# EasyEDA Pro project 15F1D_EDA.eprj

# Schematic 15F_SCH

## Sheets
1 MOT: Create Date: 2024-05-13; Page Name: MOT; Project Name: 15F1D_EDA; Schematic Name: 15F_SCH; Update Date: 2024-05-15
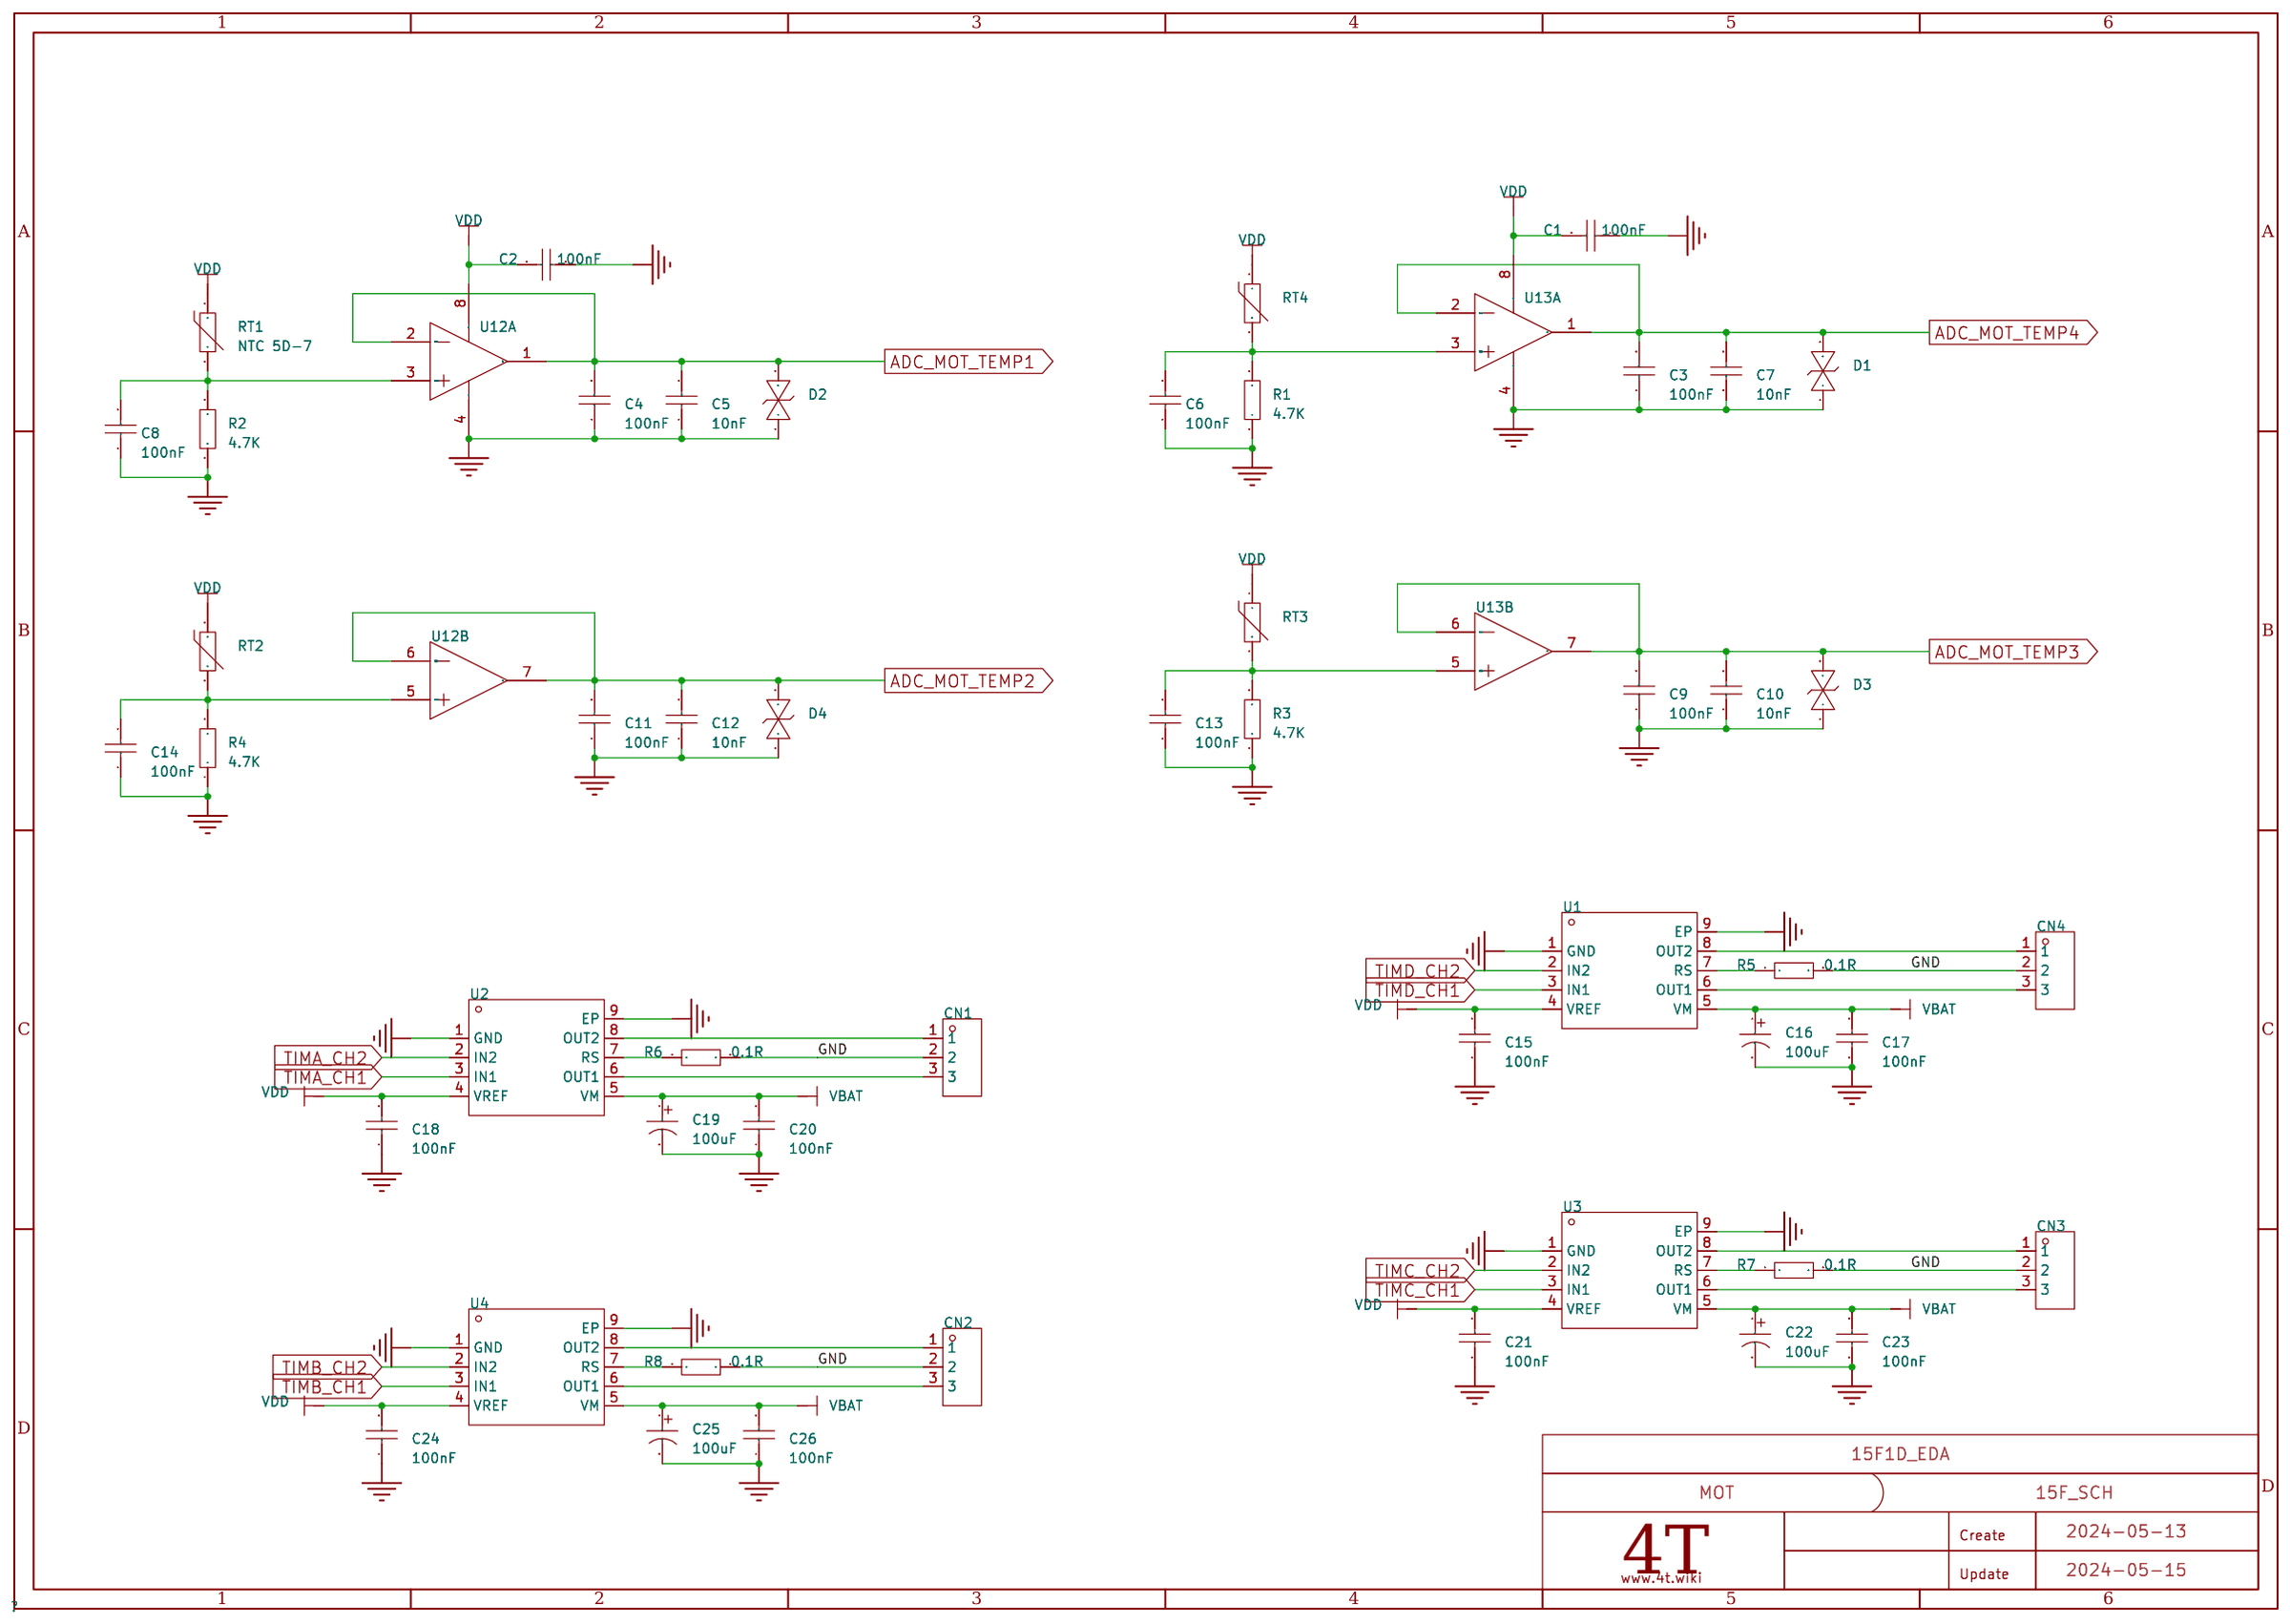
[diagram p0: MOT]
2 COM: Page Name: COM; Update Date: 2024-05-16
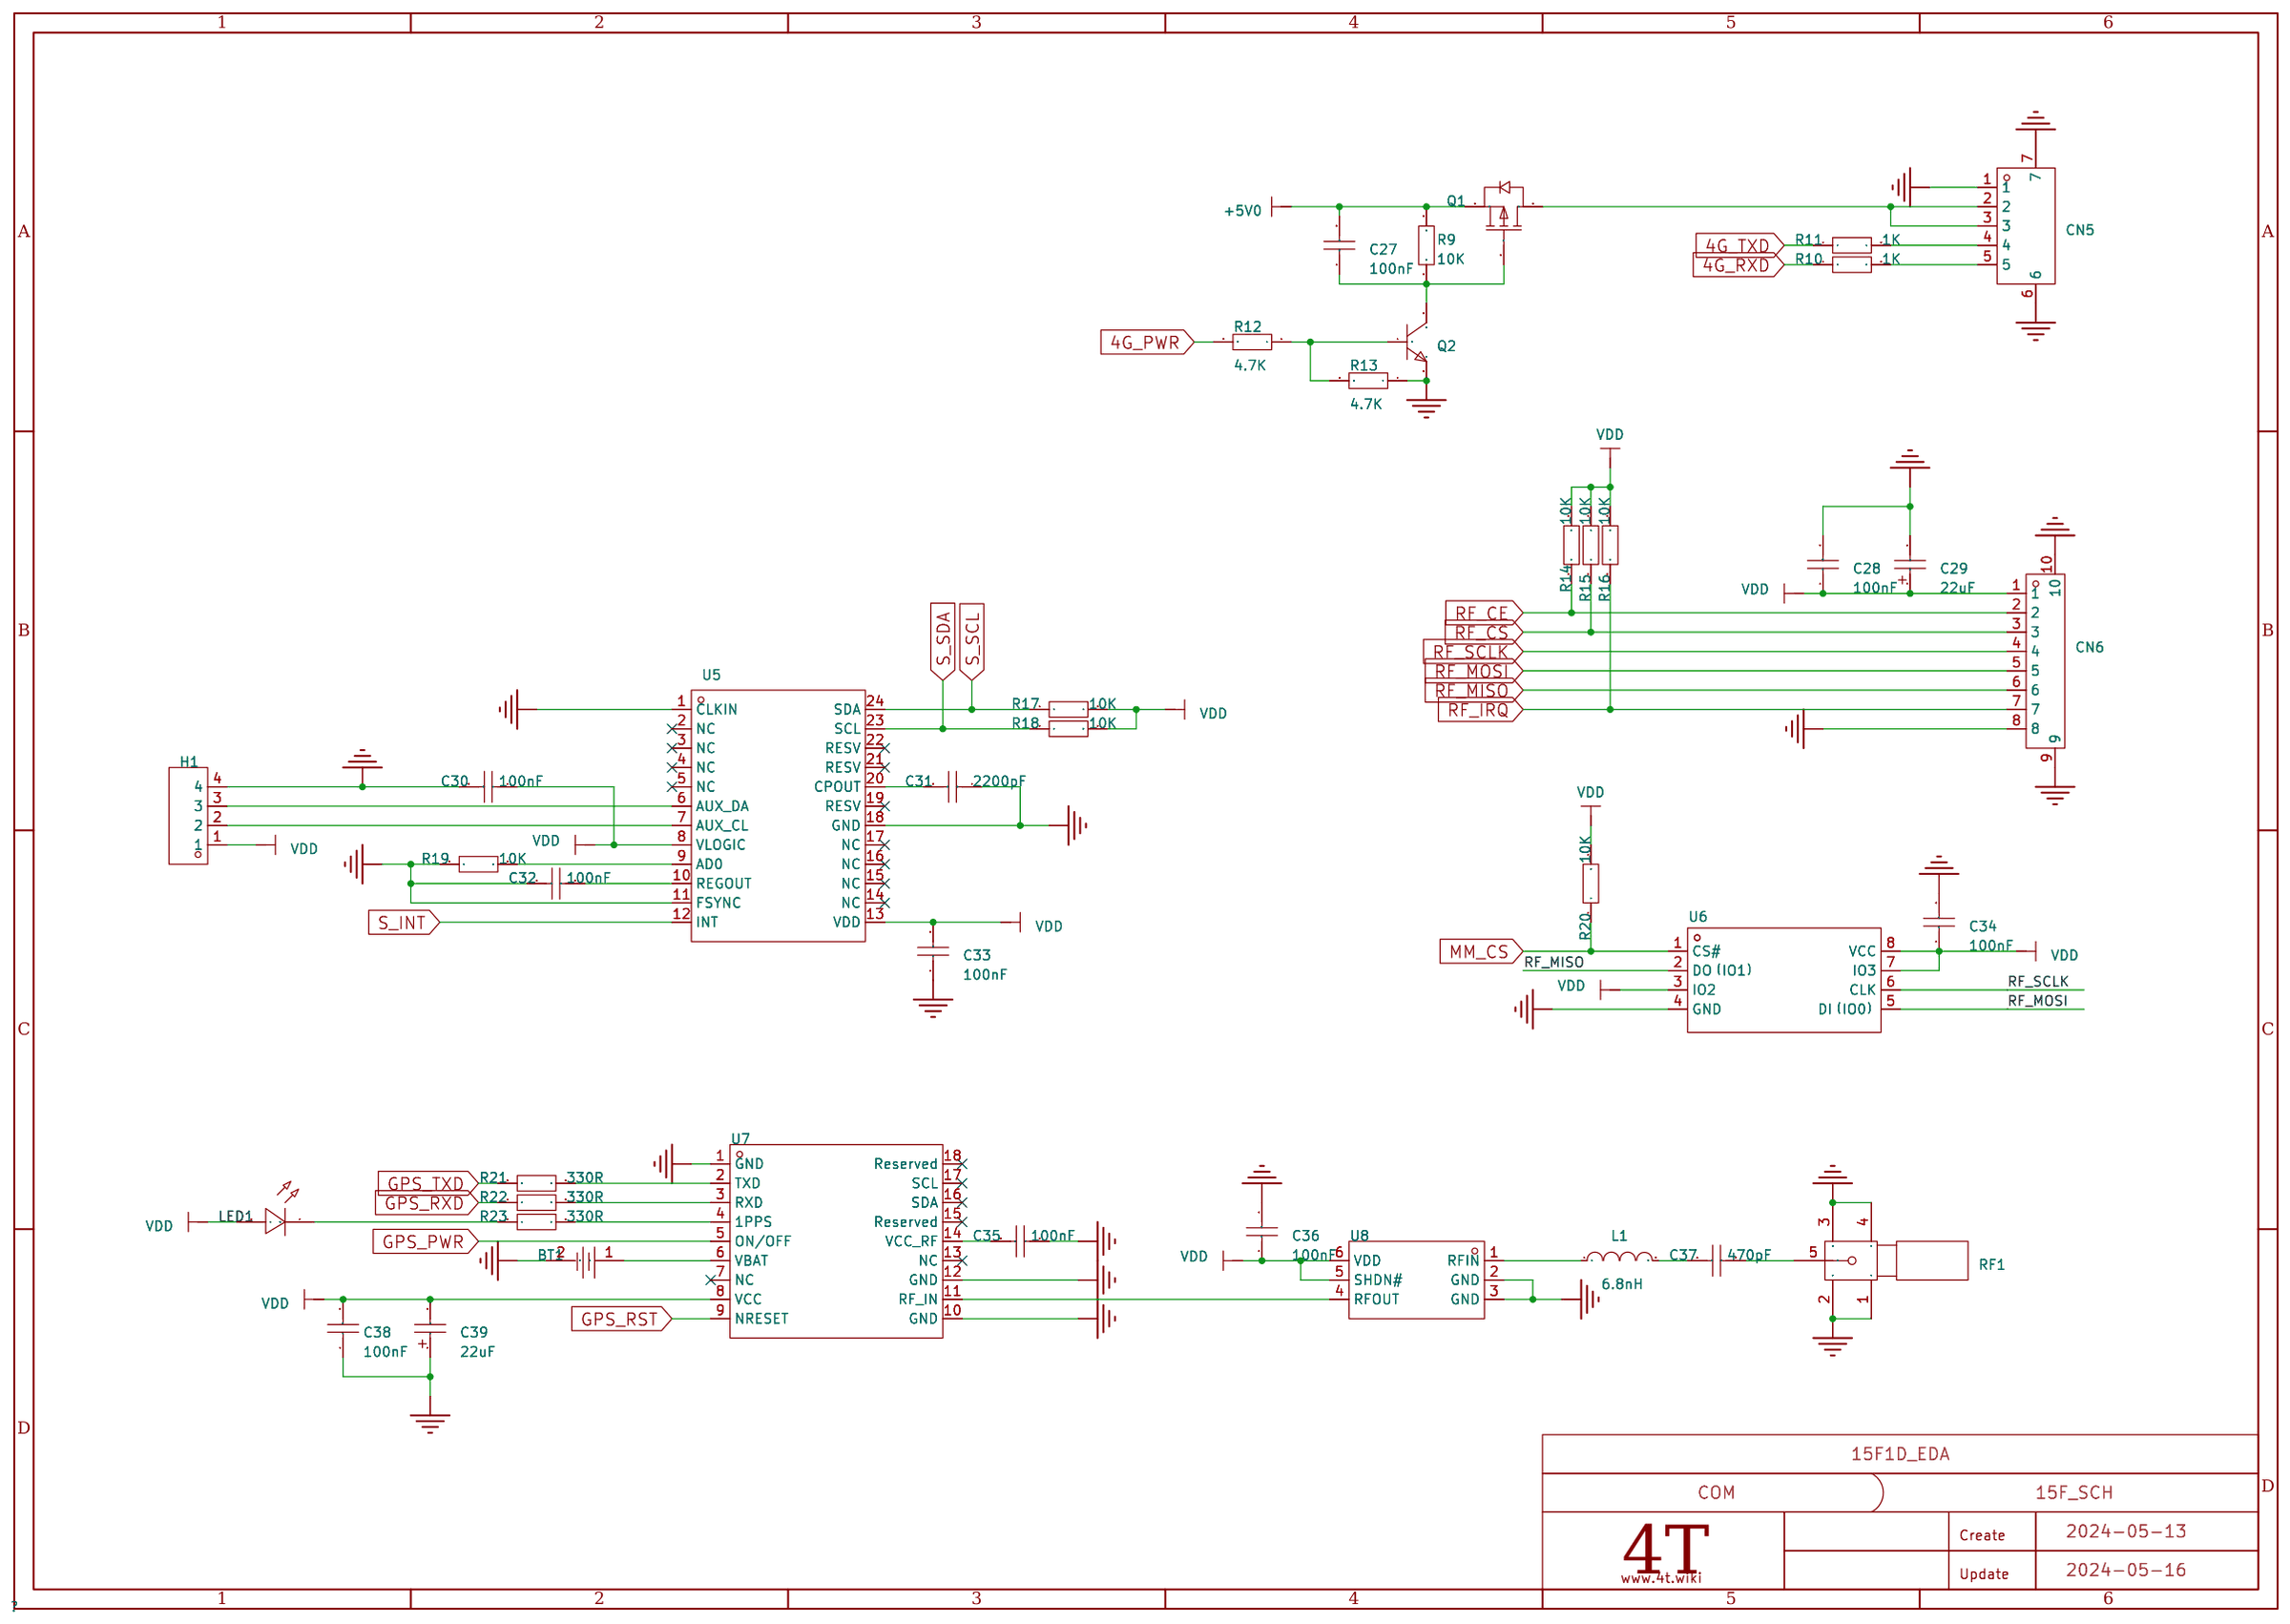
[diagram p1: COM]
3 PWR: Page Name: PWR; Update Date: 2024-05-16
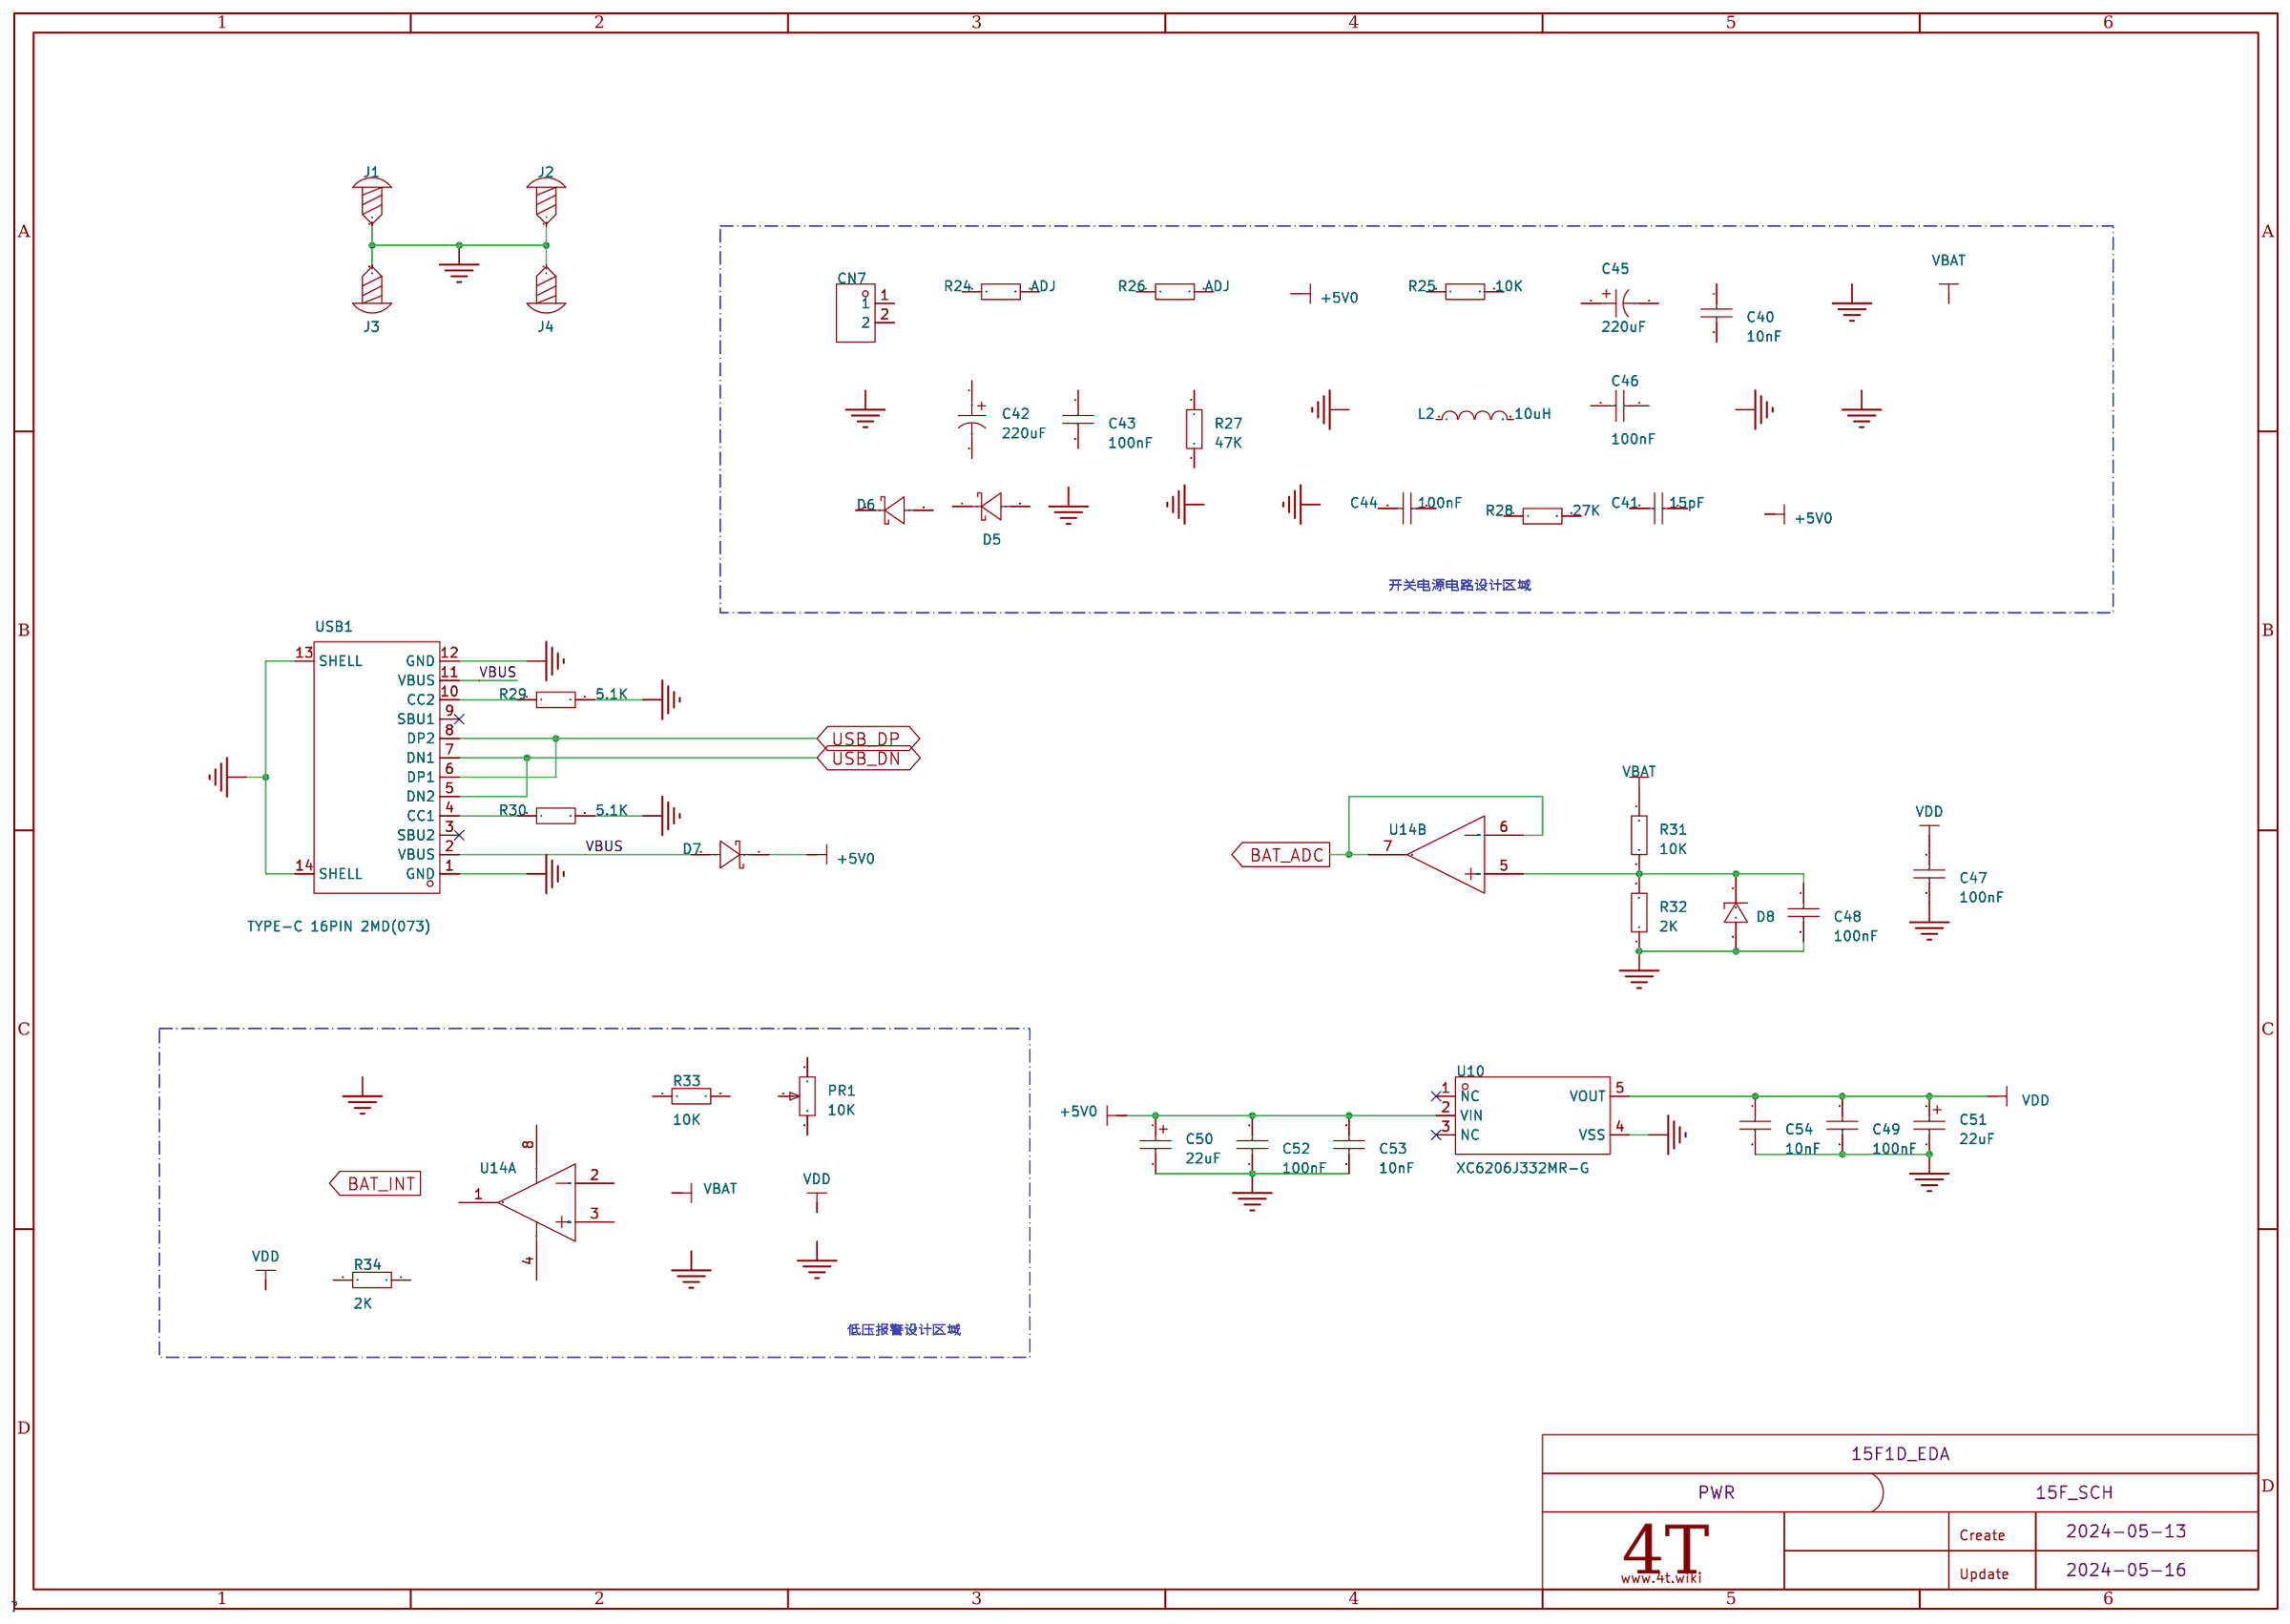
[diagram p2: PWR]
4 MCU: Page Name: MCU; Update Date: 2024-05-16